# EasyEDA Pro project PR.eprj, board 新大符2.0（下单PCB）
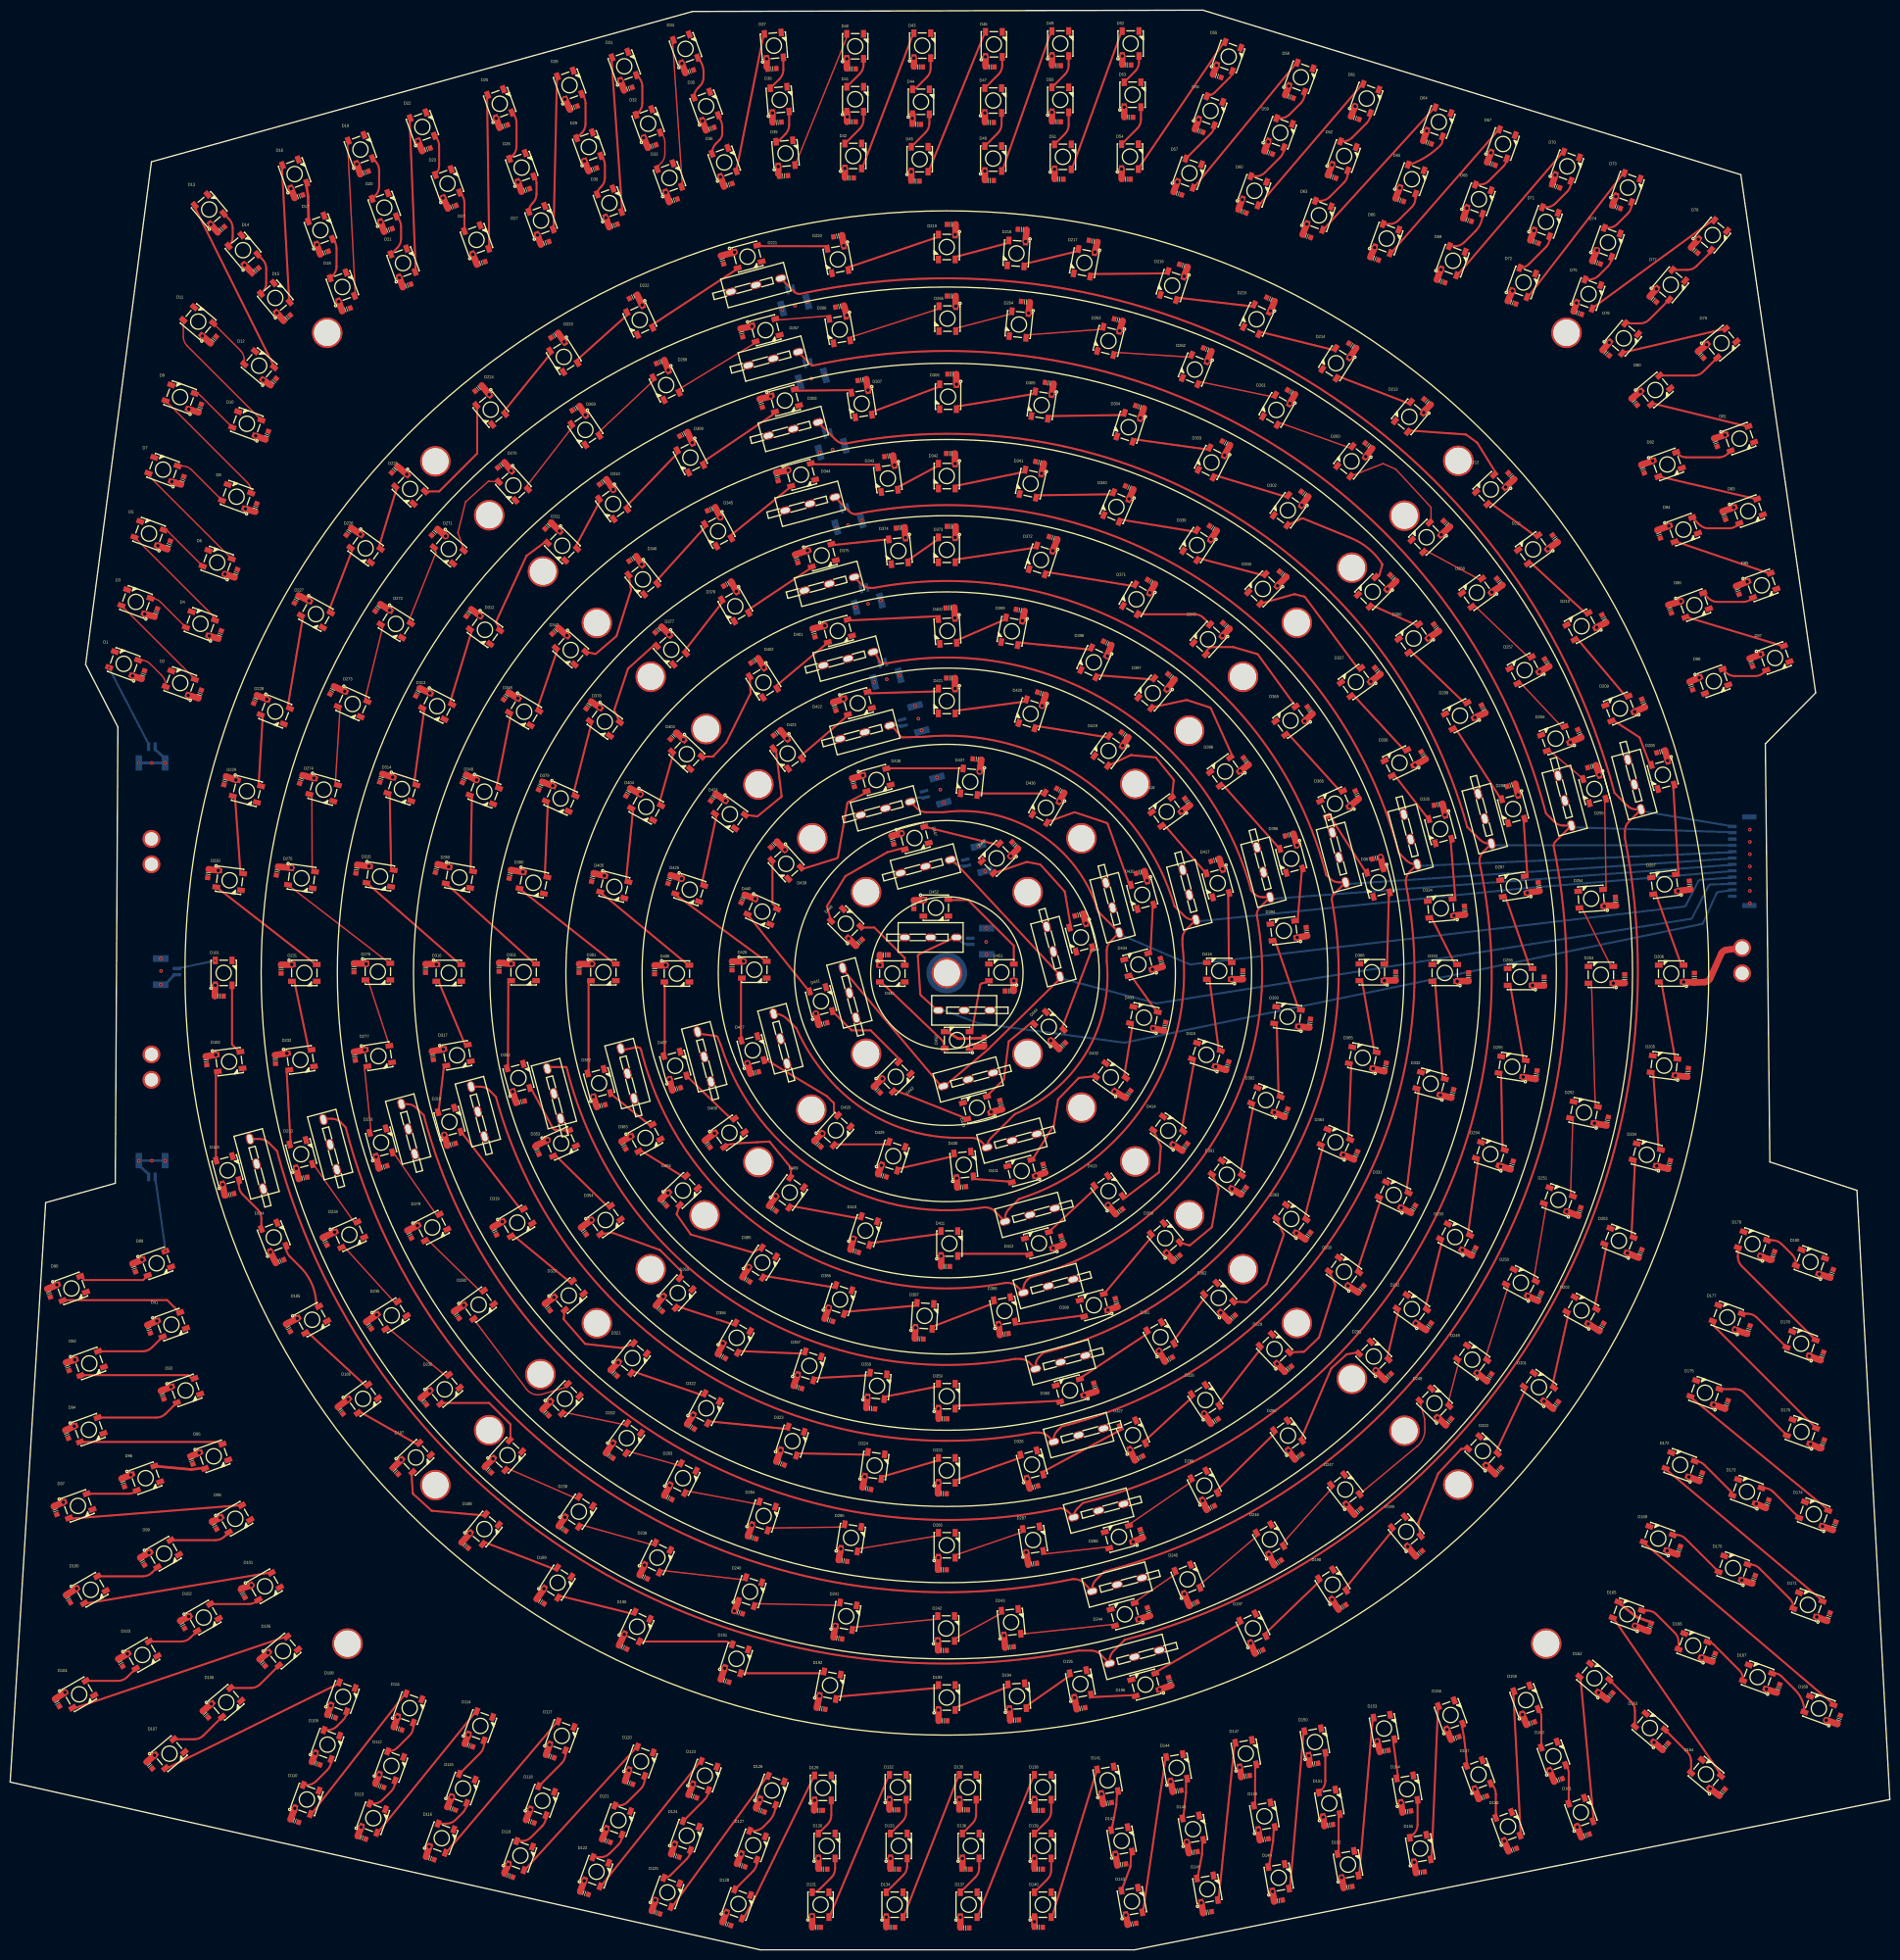
[diagram p2: board, top side]
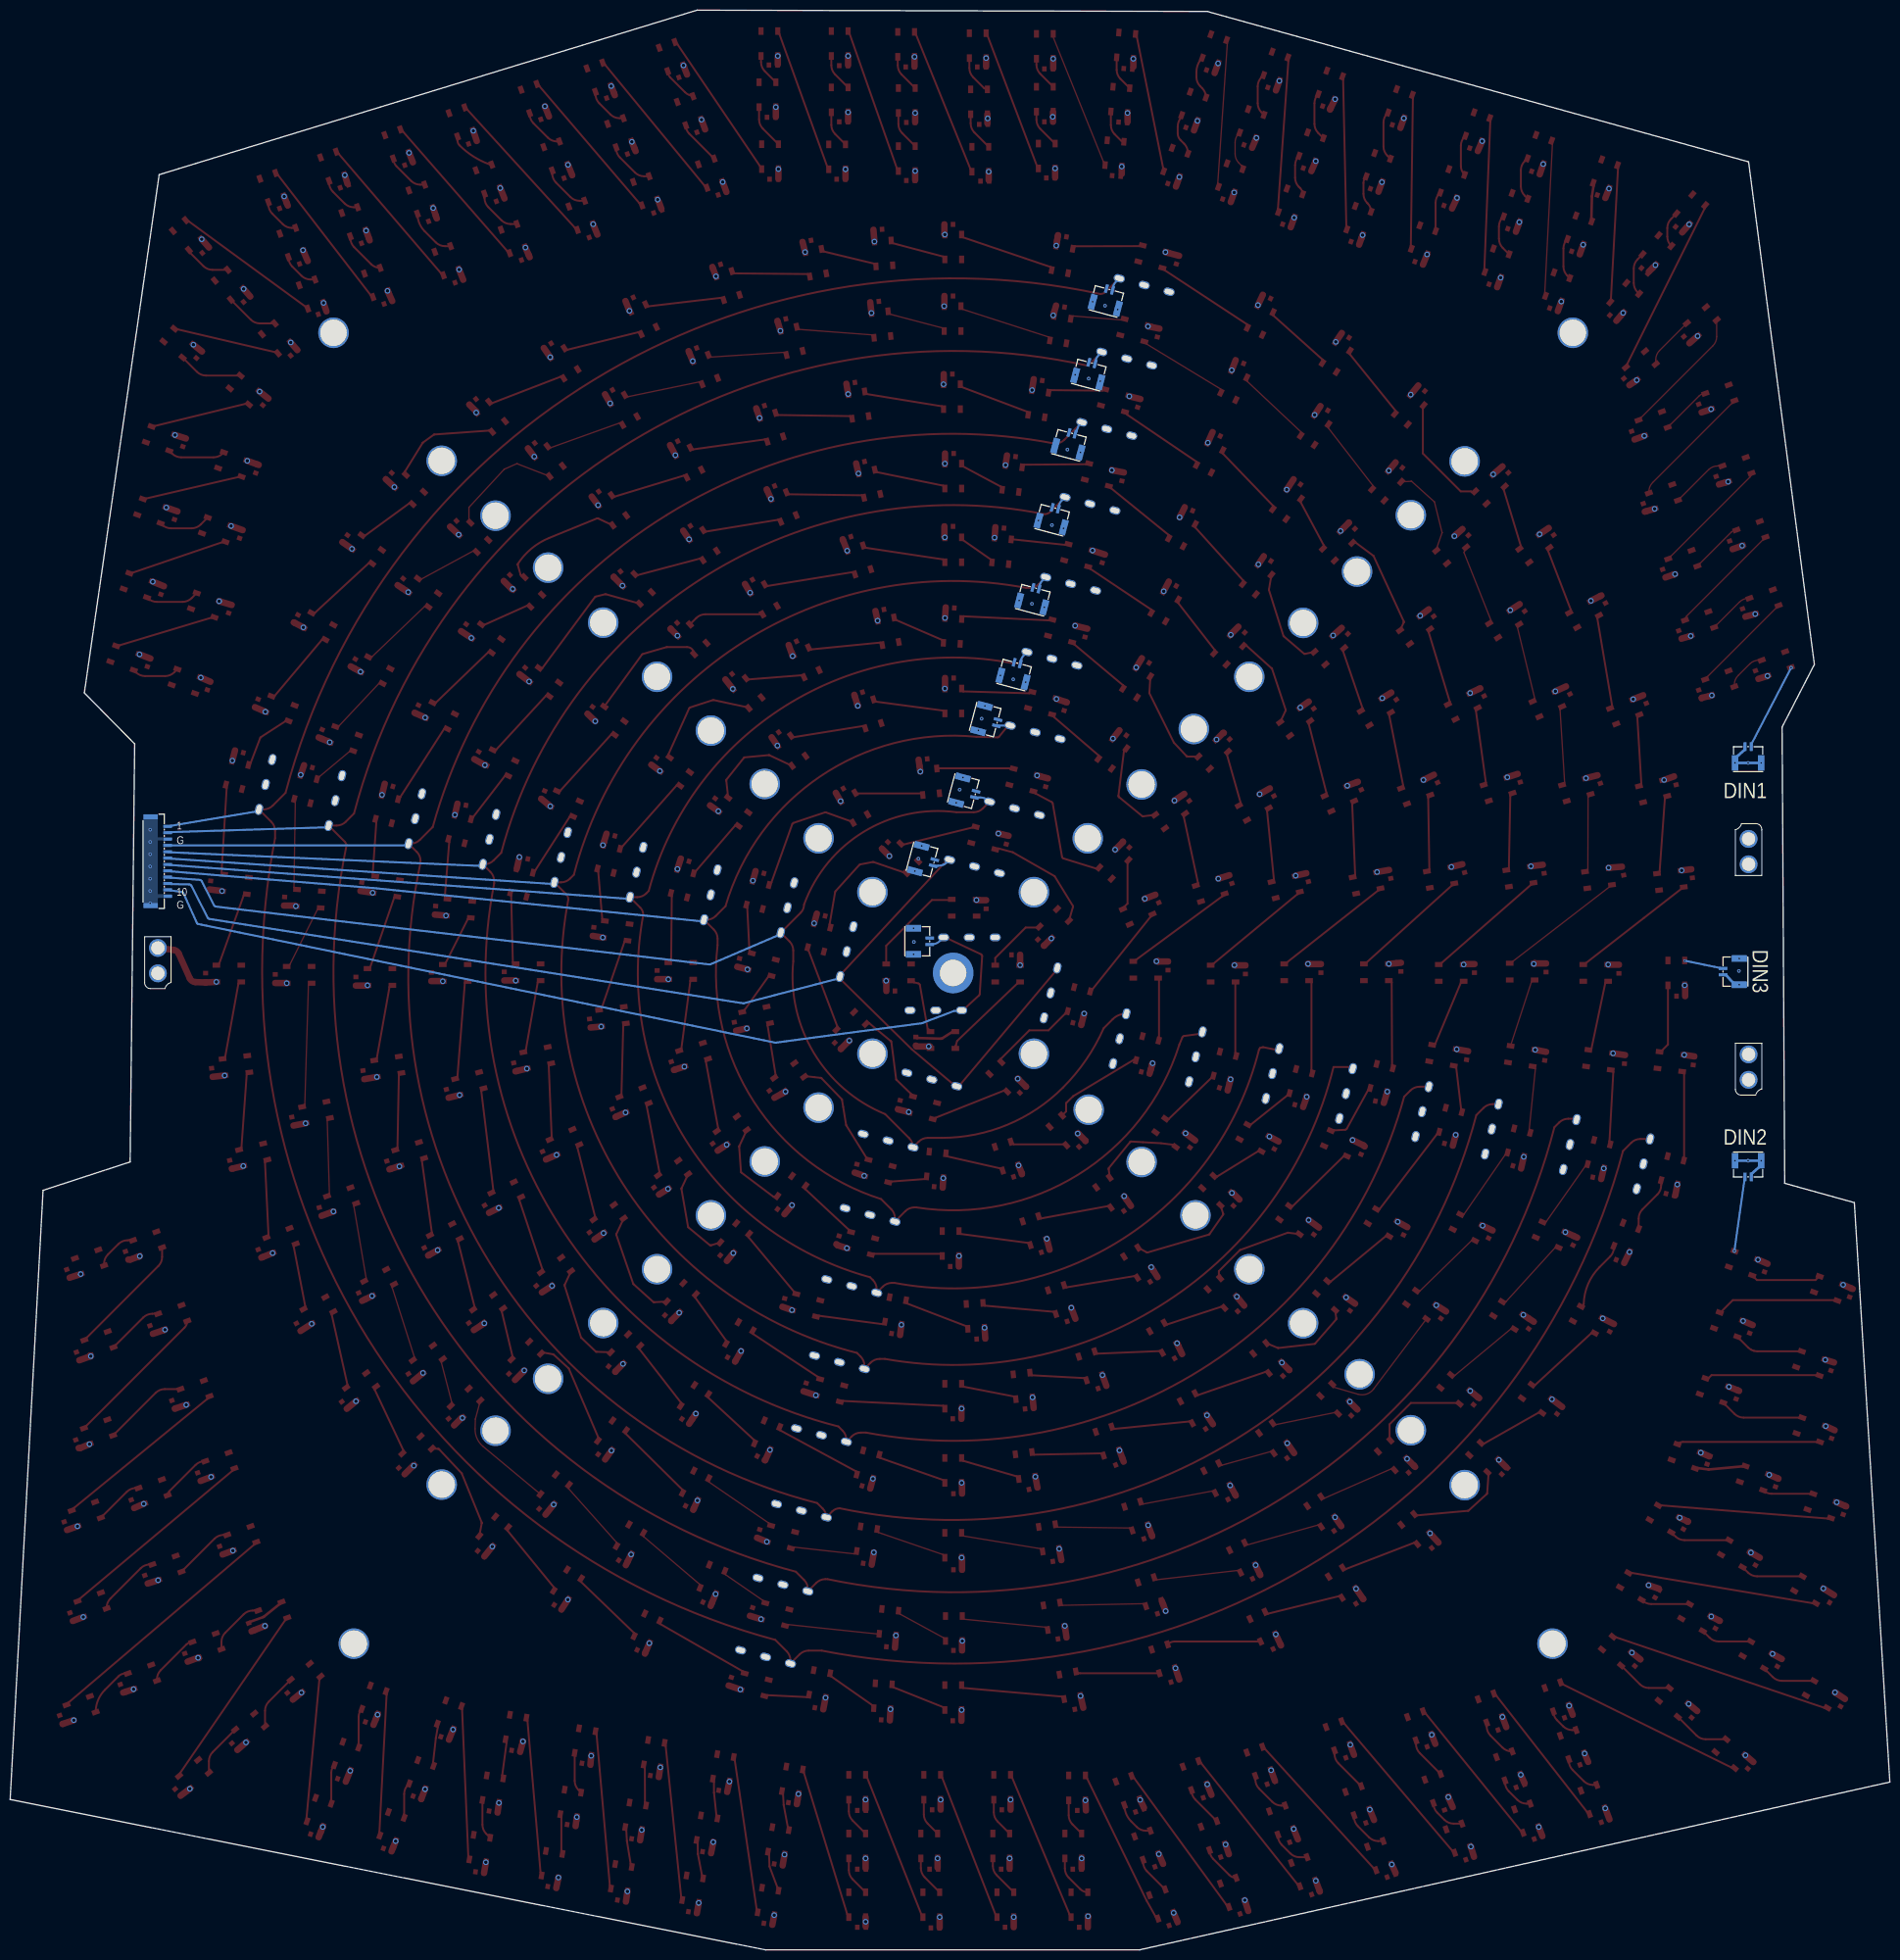
[diagram p3: board, bottom side, seen from below]

Outline 370.08 x 381.76 mm; copper layers: Top Layer, Bottom Layer. Coordinates in mm from the lower left corner of the outline.
Outline path: 0,33.02 6.98,147.07 20.7,150.88 21.21,240.67 14.86,252.98 27.81,351.92 134.37,381.51 234.82,381.76 340.74,349.38 355.47,247.4 345.57,237.36 346.46,155.07 363.6,149.48 370.08,29.59 221.34,0 147.68,0 0,33.02
Stack: Top Layer 0.0356mm / Dielectric 1 0.32mm FR-4 er 4.8 / Bottom Layer 0.0356mm

## Design rules (mm)
spacing Clearance (default): track to track 0.203, other pairs 0.203 to 0.203
track width Width_POWER (default): min 0.508, default 1.27, max 1.524
track width Width_OTHER: min 0.254, default 0.305, max 0.508
differential pair DiffPairsRouting (default): width min 0.381, default 0.381, max 0.381; gap min 0.254, default 0.254
via RoutingVias (default): diameter min 0.254, default 1.27, max 1.778; hole min 0.127, default 0.711, max 2.54

## Placement (name value [footprint] x y rotation side)
  Microswitch  [SW-TH_MICROSWITCH]  151.64 179.32 285 top
C1  100nF  [C_0603#3]  342.77 253.37 290 top
C2  100nF  [C_0603#3]  330.96 248.79 290 top
C3  100nF  [C_0603#3]  340.11 267.59 290 top
C4  100nF  [C_0603#3]  326.77 263.91 290 top
C5  100nF  [C_0603#3]  337.44 282.32 290 top
C6  100nF  [C_0603#3]  324.61 278.64 290 top
C7  100nF  [C_0603#3]  335.79 296.67 290 top
C8  100nF  [C_0603#3]  321.44 291.47 290 top
C9  100nF  [C_0603#3]  268.61 332.87 340 top
C10  100nF  [C_0603#3]  331.6 334.52 320 top
C11  100nF  [C_0603#3]  312.29 332.11 340 top
C12  100nF  [C_0603#3]  308.61 322.2 340 top
C13  100nF  [C_0603]  314.2 314.33 320 top
C14  100nF  [C_0603#3]  323.47 324.87 320 top
C15  100nF  [C_0603#3]  319.79 304.67 310 top
C16  100nF  [C_0603#3]  332.87 313.94 310 top
C17  100nF  [C_0603#3]  242.57 342.14 340 top
C18  100nF  [C_0603#3]  229.87 345.69 340 top
C19  100nF  [C_0603#3]  234.06 358.01 340 top
C20  100nF  [C_0603#3]  237.62 368.81 340 top
C21  100nF  [C_0603#3]  247.74 353.73 340 top
C22  100nF  [C_0603#3]  260.22 349 340 top
C23  100nF  [C_0603#3]  251.84 364.74 340 top
C24  100nF  [C_0603#3]  264.8 360.55 340 top
C25  100nF  [C_0603#3]  273.56 344.42 340 top
C26  100nF  [C_0603#3]  279.02 355.73 340 top
C27  100nF  [C_0603#3]  281.69 328.42 340 top
C28  100nF  [C_0603#3]  286.89 340.49 340 top
C29  100nF  [C_0603#3]  291.59 351.54 340 top
C30  100nF  [C_0603#3]  172.97 294 187.7 top
C31  100nF  [C_0603#3]  237.11 104.01 33.4 top
C32  100nF  [C_0603#3]  304.29 347.09 340 top
C33  100nF  [C_0603#3]  295.66 324.23 340 top
C34  100nF  [C_0603#3]  300.1 336.17 340 top
C35  100nF  [C_0603#3]  316.23 343.03 340 top
C36  100nF  [C_0603#3]  37.34 247.14 70 top
C37  100nF  [C_0603#3]  26.16 250.95 70 top
C38  100nF  [C_0603#3]  28.7 263.14 70 top
C39  100nF  [C_0603#3]  41.27 258.83 70 top
C40  100nF  [C_0603#3]  44.45 270.89 70 top
C41  100nF  [C_0603#3]  48.26 283.85 70 top
C42  100nF  [C_0603#3]  33.91 289.18 70 top
C43  100nF  [C_0603#3]  31.24 276.48 70 top
C44  100nF  [C_0603#3]  40.01 316.87 50 top
C45  100nF  [C_0603#3]  51.82 308.61 50 top
C46  100nF  [C_0603#3]  54.48 321.18 40 top
C47  100nF  [C_0603#3]  48.26 330.45 40 top
C48  100nF  [C_0603#3]  41.53 338.58 40 top
C49  100nF  [C_0603#3]  37.34 303.4 70 top
C50  100nF  [C_0603#3]  130.56 344.3 20 top
C51  100nF  [C_0603#3]  110.87 362.59 20 top
C52  100nF  [C_0603#3]  121.67 366.27 20 top
C53  100nF  [C_0603#3]  126.36 354.97 20 top
C54  100nF  [C_0603#3]  178.18 348.11 0 top
C55  100nF  [C_0603#3]  219.84 370.97 0 top
C56  100nF  [C_0603#3]  152.27 349.12 5 top
C57  100nF  [C_0603#3]  165.23 348.74 0 top
C58  100nF  [C_0603#3]  206.5 348.49 0 top
C59  100nF  [C_0603#3]  151 359.66 5 top
C60  100nF  [C_0603#3]  255.27 337.31 340 top
C61  100nF  [C_0603#3]  192.79 348.23 0 top
C62  100nF  [C_0603#3]  165.61 359.79 0 top
C63  100nF  [C_0603#3]  178.82 370.59 0 top
C64  100nF  [C_0603#3]  165.61 370.21 0 top
C65  100nF  [C_0603#3]  205.99 370.84 0 top
C66  100nF  [C_0603#3]  192.91 370.59 0 top
C67  100nF  [C_0603#3]  192.79 359.66 0 top
C68  100nF  [C_0603#3]  178.44 359.28 0 top
C69  100nF  [C_0603#3]  149.99 370.21 5 top
C70  100nF  [C_0603#3]  205.99 359.79 0 top
C71  100nF  [C_0603#3]  92.71 331.98 20 top
C72  100nF  [C_0603#3]  118.75 339.34 20 top
C73  100nF  [C_0603#3]  97.16 358.9 20 top
C74  100nF  [C_0603#3]  220.22 360.68 0 top
C75  100nF  [C_0603#3]  114.68 350.39 20 top
C76  100nF  [C_0603#3]  87 343.03 20 top
C77  100nF  [C_0603#3]  137.8 358.39 20 top
C78  100nF  [C_0603#3]  101.47 346.33 20 top
C79  100nF  [C_0603#3]  105.28 335.92 20 top
C80  100nF  [C_0603#3]  219.71 348.49 0 top
C81  100nF  [C_0603#3]  78.1 327.53 20 top
C82  100nF  [C_0603#3]  69.72 349.76 20 top
C83  100nF  [C_0603#3]  81.91 354.33 20 top
C84  100nF  [C_0603#3]  74.42 338.46 20 top
C85  100nF  [C_0603#3]  56.81 345.1 20 top
C86  100nF  [C_0603#3]  61.85 334.01 20 top
C87  100nF  [C_0603#3]  133.73 369.7 20 top
C88  100nF  [C_0603#3]  66.17 322.83 20 top
C89  100nF  [C_0603#3]  26.03 76.45 300 top
C90  100nF  [C_0603#3]  117.35 21.46 340 top
C91  100nF  [C_0603#3]  7.62 129.29 290 top
C92  100nF  [C_0603#3]  24.38 134.24 290 top
C93  100nF  [C_0603#3]  314.96 49.91 50 top
C94  100nF  [C_0603#3]  45.8 70.08 300 top
C95  100nF  [C_0603#3]  113.03 11.18 340 top
C96  100nF  [C_0603#3]  11.18 101.47 290 top
C97  100nF  [C_0603#3]  141.1 5.08 340 top
C98  100nF  [C_0603#3]  35.69 96.39 290 top
C99  100nF  [C_0603#3]  11.3 114.81 290 top
C100  100nF  [C_0603#3]  158.75 4.44 0 top
C101  100nF  [C_0603#3]  27.3 122.17 290 top
C102  100nF  [C_0603#3]  246.89 21.72 10 top
C103  100nF  [C_0603#3]  243.2 34.16 10 top
C104  100nF  [C_0603#3]  335.41 57.53 70 top
C105  100nF  [C_0603#3]  322.83 63.5 70 top
C106  100nF  [C_0603#3]  360.04 45.34 70 top
C107  100nF  [C_0603#3]  249.68 9.65 10 top
C108  100nF  [C_0603#3]  348.11 51.44 70 top
C109  100nF  [C_0603#3]  76.33 43.56 340 top
C110  100nF  [C_0603#3]  9.27 48.64 300 top
C111  100nF  [C_0603#3]  22.22 91.95 290 top
C112  100nF  [C_0603#3]  63.25 45.97 340 top
C113  100nF  [C_0603#3]  69.22 22.1 340 top
C114  100nF  [C_0603#3]  72.77 32.26 340 top
C115  100nF  [C_0603#3]  40.21 83.54 300 top
C116  100nF  [C_0603#3]  8.89 86.49 290 top
C117  100nF  [C_0603#3]  21.72 56.52 300 top
C118  100nF  [C_0603#3]  33.91 64.01 300 top
C119  100nF  [C_0603#4]  11.43 69.09 300 top
C120  100nF  [C_0603#3]  202.44 27.43 0 top
C121  100nF  [C_0603#3]  220.85 5.08 10 top
C122  100nF  [C_0603#3]  218.82 16.76 10 top
C123  100nF  [C_0603#3]  60.2 36.7 340 top
C124  100nF  [C_0603#3]  173.36 4.44 0 top
C125  100nF  [C_0603#3]  202.44 4.44 0 top
C126  100nF  [C_0603#3]  216.03 28.83 10 top
C127  100nF  [C_0603#3]  310.13 22.48 20 top
C128  100nF  [C_0603#3]  337.06 30.99 50 top
C129  100nF  [C_0603]  325.88 40.01 50 top
C130  100nF  [C_0603#3]  256.67 36.58 10 top
C131  100nF  [C_0603#3]  299.34 44.58 20 top
C132  100nF  [C_0603#3]  304.8 33.4 20 top
C133  100nF  [C_0603#3]  121.79 32.89 340 top
C134  100nF  [C_0603#3]  147.7 27.43 340 top
C135  100nF  [C_0603#3]  143.89 16.64 340 top
C136  100nF  [C_0603#3]  130.94 18.54 340 top
C137  100nF  [C_0603#3]  134.37 30.23 340 top
C138  100nF  [C_0603#3]  29.97 109.22 290 top
C139  100nF  [C_0603#3]  332.87 93.09 70 top
C140  100nF  [C_0603#3]  359.16 83.44 70 top
C141  100nF  [C_0603#3]  358.01 65.53 70 top
C142  100nF  [C_0603#3]  328.55 78.61 70 top
C143  100nF  [C_0603#3]  343.28 72.9 70 top
C144  100nF  [C_0603#3]  232.92 19.18 10 top
C145  100nF  [C_0603#3]  82.68 18.03 340 top
C146  100nF  [C_0603#3]  263.4 12.32 10 top
C147  100nF  [C_0603#3]  289.94 29.97 20 top
C148  100nF  [C_0603#3]  259.59 24.51 10 top
C149  100nF  [C_0603#4]  86.87 27.81 340 top
C150  100nF  [C_0603#3]  106.3 38.1 340 top
C151  100nF  [C_0603#3]  127.13 7.37 340 top
C152  100nF  [C_0603#3]  102.36 25.27 340 top
C153  100nF  [C_0603#3]  90.3 40.26 340 top
C154  100nF  [C_0603#3]  98.17 14.61 340 top
C155  100nF  [C_0603#3]  187.96 4.32 0 top
C156  100nF  [C_0603#3]  27.43 36.32 310 top
C157  100nF  [C_0603#3]  38.48 46.36 310 top
C158  100nF  [C_0603#3]  49.66 56.52 310 top
C159  100nF  [C_0603#3]  56.01 25.4 340 top
C160  100nF  [C_0603#3]  173.99 27.56 0 top
C161  100nF  [C_0603#3]  188.21 15.88 0 top
C162  100nF  [C_0603#3]  202.44 15.88 0 top
C163  100nF  [C_0603#3]  187.71 27.56 0 top
C164  100nF  [C_0603#3]  174.12 15.88 0 top
C165  100nF  [C_0603#3]  159.13 27.43 0 top
C166  100nF  [C_0603#3]  160.02 15.88 0 top
C167  100nF  [C_0603#3]  270.51 39.12 10 top
C168  100nF  [C_0603#3]  274.95 27.18 10 top
C169  100nF  [C_0603#3]  141.35 347.35 20 top
C170  100nF  [C_0603#3]  50.55 298.07 70 top
C171  100nF  [C_0603#3]  342.26 122.05 70 top
C172  100nF  [C_0603#3]  356.74 116.84 70 top
C173  100nF  [C_0603#3]  356.87 99.57 70 top
C174  100nF  [C_0603#3]  337.95 107.32 70 top
C175  100nF  [C_0603#3]  358.65 133.1 70 top
C176  100nF  [C_0603#3]  229.74 31.24 10 top
C177  100nF  [C_0603#3]  235.71 7.37 10 top
C178  100nF  [C_0603#3]  295.78 19.69 20 top
C179  100nF  [C_0603#3]  284.48 41.66 20 top
C180  100nF  [C_0603#3]  347.09 136.65 70 top
C181  100nF  [C_0603#3]  331.6 191.39 90 top
C182  100nF  [C_0603#3]  330.31 172.67 82.8 top
C183  100nF  [C_0603#3]  326.64 154.56 75.6 top
C184  100nF  [C_0603#3]  320.93 137.03 68.4 top
C185  100nF  [C_0603#3]  313.31 122.56 61.2 top
C186  100nF  [C_0603#3]  304.29 107.19 54 top
C187  100nF  [C_0603#3]  292.99 94.23 46.8 top
C188  100nF  [C_0603#3]  277.37 77.98 39.6 top
C189  100nF  [C_0603#3]  262.25 67.44 32.4 top
C190  100nF  [C_0603#3]  245.87 58.67 25.2 top
C191  100nF  [C_0603#3]  228.35 52.83 108 top
C192  100nF  [C_0603#3]  210.82 47.5 10.8 top
C193  100nF  [C_0603#3]  197.74 45.21 3.6 top
C194  100nF  [C_0603#3]  183.64 45.09 0 top
C195  100nF  [C_0603#3]  159.64 47.5 349.2 top
C196  100nF  [C_0603#3]  140.72 52.96 342 top
C197  100nF  [C_0603#3]  120.65 59.56 334.8 top
C198  100nF  [C_0603#3]  104.39 68.58 327.6 top
C199  100nF  [C_0603#3]  89.53 79.63 320.4 top
C200  100nF  [C_0603#3]  75.82 94.23 313.2 top
C201  100nF  [C_0603#3]  65.02 106.17 306 top
C202  100nF  [C_0603#3]  54.74 122.43 298.8 top
C203  100nF  [C_0603#3]  53.09 135.51 21.6 top
C204  100nF  [C_0603#3]  43.25 148.63 14.4 top
C205  100nF  [C_0603#3]  38.61 175.01 277.2 top
C206  100nF  [C_0603#3]  41.15 187.71 0 top
C207  100nF  [C_0603#3]  38.99 211.84 262.8 top
C208  100nF  [C_0603#3]  42.29 230.12 255.6 top
C209  100nF  [C_0603#3]  48.26 246.13 248.4 top
C210  100nF  [C_0603#3]  56.39 265.81 241.2 top
C211  100nF  [C_0603#3]  66.67 279.15 234 top
C212  100nF  [C_0603#3]  75.69 291.34 226.8 top
C213  100nF  [C_0603#3]  92.2 307.34 219.6 top
C214  100nF  [C_0603#3]  107.19 317.75 212.4 top
C215  100nF  [C_0603#3]  122.68 325.37 205.2 top
C216  100nF  [C_0603#3]  140.21 332.61 288 top
C217  100nF  [C_0603#3]  162.94 337.31 190.8 top
C218  100nF  [C_0603#3]  185.29 339.6 180 top
C219  100nF  [C_0603#3]  199.26 338.58 176.4 top
C220  100nF  [C_0603#3]  213.23 336.3 169.2 top
C221  100nF  [C_0603#3]  231.01 331.47 162 top
C222  100nF  [C_0603#3]  248.16 324.87 154.8 top
C223  100nF  [C_0603#3]  264.29 315.72 147.6 top
C224  100nF  [C_0603#3]  279.02 304.67 140.4 top
C225  100nF  [C_0603#3]  295.53 290.07 133.2 top
C226  100nF  [C_0603#3]  304.16 277.75 126 top
C227  100nF  [C_0603#3]  313.82 262 118.8 top
C228  100nF  [C_0603#3]  321.56 245.36 111.6 top
C229  100nF  [C_0603#3]  324.99 235.84 195 top
C230  100nF  [C_0603#3]  330.71 209.55 97.2 top
C231  100nF  [C_0603#3]  317.88 191.14 90 top
C232  100nF  [C_0603#3]  314.45 163.07 78 top
C233  100nF  [C_0603#3]  308.99 145.29 74 top
C234  100nF  [C_0603#3]  301.12 128.52 66 top
C235  100nF  [C_0603#3]  291.21 112.65 58 top
C236  100nF  [C_0603#3]  283.21 103.89 50 top
C237  100nF  [C_0603#3]  265.3 86.23 42 top
C238  100nF  [C_0603#3]  249.56 76.2 34 top
C239  100nF  [C_0603#3]  232.92 68.07 26 top
C240  100nF  [C_0603#3]  224.15 66.55 108 top
C241  100nF  [C_0603#3]  196.72 59.56 6 top
C242  100nF  [C_0603#3]  183.51 58.93 0 top
C243  100nF  [C_0603#3]  162.94 61.34 350 top
C244  100nF  [C_0603#3]  143.38 66.42 342 top
C245  100nF  [C_0603#3]  124.71 73.41 334 top
C246  100nF  [C_0603#3]  108.71 82.93 326 top
C247  100nF  [C_0603#3]  94.11 94.49 318 top
C248  100nF  [C_0603#3]  81.41 107.95 310 top
C249  100nF  [C_0603#3]  70.61 122.94 306 top
C250  100nF  [C_0603#3]  61.98 139.45 298 top
C251  100nF  [C_0603#3]  163.32 323.47 190 top
C252  100nF  [C_0603#3]  57.66 151.89 12 top
C253  100nF  [C_0603#3]  52.2 175.26 274 top
C254  100nF  [C_0603#3]  53.34 193.04 270 top
C255  100nF  [C_0603#3]  52.58 212.34 258 top
C256  100nF  [C_0603#3]  57.28 230.38 250 top
C257  100nF  [C_0603#3]  63.37 247.9 242 top
C258  100nF  [C_0603#3]  72.39 264.16 234 top
C259  100nF  [C_0603#3]  83.57 279.02 226 top
C260  100nF  [C_0603#3]  96.65 292.23 218 top
C261  100nF  [C_0603#3]  111.38 303.4 210 top
C262  100nF  [C_0603#3]  128.02 312.55 202 top
C263  100nF  [C_0603#3]  144.02 318.26 284 top
C264  100nF  [C_0603#3]  185.29 325.5 180 top
C265  100nF  [C_0603#3]  199.9 324.36 174 top
C266  100nF  [C_0603#3]  218.19 320.8 166 top
C267  100nF  [C_0603#3]  235.71 314.96 158 top
C268  100nF  [C_0603#3]  252.22 306.58 150 top
C269  100nF  [C_0603#3]  267.46 296.04 142 top
C270  100nF  [C_0603#3]  282.83 280.67 138 top
C271  100nF  [C_0603#3]  293.24 269.24 130 top
C272  100nF  [C_0603#3]  302.57 253.32 122 top
C273  100nF  [C_0603#3]  308.99 239.4 114 top
C274  100nF  [C_0603#3]  311.4 232.92 196 top
C275  100nF  [C_0603#3]  316.1 206.38 94 top
C276  100nF  [C_0603#3]  302.01 190.63 90 top
C277  100nF  [C_0603#3]  300.48 172.21 81 top
C278  100nF  [C_0603#3]  295.66 154.43 72 top
C279  100nF  [C_0603#3]  288.16 137.41 63 top
C280  100nF  [C_0603#3]  279.27 122.68 54 top
C281  100nF  [C_0603#3]  271.27 112.78 45 top
C282  100nF  [C_0603#3]  253.62 97.03 36 top
C283  100nF  [C_0603#3]  236.35 87 27 top
C284  100nF  [C_0603#3]  222.76 81.92 108 top
C285  100nF  [C_0603#3]  201.3 75.95 9 top
C286  100nF  [C_0603#3]  183.51 74.8 0 top
C287  100nF  [C_0603#3]  163.96 76.58 351 top
C288  100nF  [C_0603#3]  146.05 81.15 342 top
C289  100nF  [C_0603#3]  129.54 89.03 333 top
C290  100nF  [C_0603#3]  117.98 97.28 324 top
C291  100nF  [C_0603#3]  105.44 105.76 315 top
C292  100nF  [C_0603#3]  87.88 124.97 306 top
C293  100nF  [C_0603#3]  78.61 140.84 297 top
C294  100nF  [C_0603#3]  73.41 154.05 18 top
C295  100nF  [C_0603#3]  67.82 175.9 279 top
C296  100nF  [C_0603#3]  67.69 193.29 270 top
C297  100nF  [C_0603#3]  68.2 212.73 261 top
C298  100nF  [C_0603#3]  73.03 230.63 252 top
C299  100nF  [C_0603#3]  80.26 247.53 243 top
C300  100nF  [C_0603#3]  90.3 263.14 234 top
C301  100nF  [C_0603#3]  105.92 280.29 225 top
C302  100nF  [C_0603#3]  116.71 288.93 216 top
C303  100nF  [C_0603#3]  132.59 298.32 207 top
C304  100nF  [C_0603#3]  147.83 304.42 288 top
C305  100nF  [C_0603#3]  167.72 309 189 top
C306  100nF  [C_0603#3]  185.42 310.13 180 top
C307  100nF  [C_0603#3]  204.6 308.36 171 top
C308  100nF  [C_0603#3]  222.38 303.66 162 top
C309  100nF  [C_0603#3]  239.39 296.55 153 top
C310  100nF  [C_0603#3]  254.89 286.51 144 top
C311  100nF  [C_0603#3]  272.29 270 135 top
C312  100nF  [C_0603#3]  280.8 260.22 126 top
C313  100nF  [C_0603#3]  290.07 244.22 117 top
C314  100nF  [C_0603#3]  295.53 229.24 198 top
C315  100nF  [C_0603#3]  300.98 209.25 99 top
C316  100nF  [C_0603#3]  286.38 204.6 95 top
C317  100nF  [C_0603#3]  287.15 191.52 90 top
C318  100nF  [C_0603#3]  283.97 168.53 74.6 top
C319  100nF  [C_0603#3]  276.23 145.8 59.1 top
C320  100nF  [C_0603#3]  265.94 130.05 48.9 top
C321  100nF  [C_0603#3]  251.59 114.3 38.6 top
C322  100nF  [C_0603#3]  222.25 96.77 28.3 top
C323  100nF  [C_0603#3]  201.55 91.06 18 top
C324  100nF  [C_0603#3]  277.62 15.24 7.7 top
C325  100nF  [C_0603#3]  183.51 89.79 359 top
C326  100nF  [C_0603#3]  168.66 90.81 347.1 top
C327  100nF  [C_0603#3]  151.64 95.76 336.9 top
C328  100nF  [C_0603#3]  133.99 103 326.6 top
C329  100nF  [C_0603#3]  118.87 113.54 316.3 top
C330  100nF  [C_0603#3]  105.79 126.49 306 top
C331  100nF  [C_0603#3]  95.38 141.48 295.7 top
C332  100nF  [C_0603#3]  83.19 176.02 280 top
C333  100nF  [C_0603#3]  81.79 193.17 270 top
C334  100nF  [C_0603#3]  86.87 158.5 15 top
C335  100nF  [C_0603#3]  83.95 212.85 254.6 top
C336  100nF  [C_0603#3]  89.41 230.51 244.3 top
C337  100nF  [C_0603#3]  97.66 246.76 234 top
C338  100nF  [C_0603#2]  107.31 259.59 223.7 top
C339  100nF  [C_0603#3]  122.55 273.81 213.4 top
C340  100nF  [C_0603#3]  138.05 283.59 203.2 top
C341  100nF  [C_0603#3]  151 289.94 282.9 top
C342  100nF  [C_0603#3]  185.17 294.51 180 top
C343  100nF  [C_0603#3]  202.69 292.74 167.1 top
C344  100nF  [C_0603#3]  220.35 287.78 156.9 top
C345  100nF  [C_0603#3]  236.86 279.78 146.6 top
C346  100nF  [C_0603#3]  250.57 270.76 141.4 top
C347  100nF  [C_0603#3]  269.24 251.71 131.2 top
C348  100nF  [C_0603#3]  278.26 235.08 120.9 top
C349  100nF  [C_0603#3]  195.71 121.16 10 top
C350  100nF  [C_0603#3]  281.18 225.43 190.3 top
C351  100nF  [C_0603#3]  272.8 191.64 90 top
C352  100nF  [C_0603#3]  270.76 173.74 78 top
C353  100nF  [C_0603#3]  264.92 156.34 66 top
C354  100nF  [C_0603#3]  255.52 140.51 54 top
C355  100nF  [C_0603#3]  240.54 124.33 42 top
C356  100nF  [C_0603#3]  228.09 116.21 30 top
C357  100nF  [C_0603#3]  213.61 110.74 108 top
C358  100nF  [C_0603#3]  183.64 104.52 0 top
C359  100nF  [C_0603#3]  169.42 106.55 354 top
C360  100nF  [C_0603#3]  155.07 110.74 342 top
C361  100nF  [C_0603#3]  140.08 116.84 330 top
C362  100nF  [C_0603#3]  127.76 126.24 318 top
C363  100nF  [C_0603#3]  112.9 141.48 306 top
C364  100nF  [C_0603#3]  103.76 157.35 294 top
C365  100nF  [C_0603#3]  100.46 166.88 12 top
C366  100nF  [C_0603#3]  96.27 193.42 270 top
C367  100nF  [C_0603#3]  98.42 211.71 258 top
C368  100nF  [C_0603#3]  104.39 229.11 246 top
C369  100nF  [C_0603#3]  113.92 244.98 234 top
C370  100nF  [C_0603#3]  127.64 259.84 222 top
C371  100nF  [C_0603#3]  141.22 268.86 210 top
C372  100nF  [C_0603#3]  154.81 273.81 288 top
C373  100nF  [C_0603#3]  175.26 279.91 186 top
C374  100nF  [C_0603#3]  185.29 280.16 180 top
C375  100nF  [C_0603#3]  205.36 277.88 162 top
C376  100nF  [C_0603#3]  224.66 269.24 150 top
C377  100nF  [C_0603#3]  239.39 260.6 138 top
C378  100nF  [C_0603#3]  255.9 243.97 126 top
C379  100nF  [C_0603#3]  265.18 227.33 114 top
C380  100nF  [C_0603#3]  268.99 214.88 192 top
C381  100nF  [C_0603#3]  255.27 200.41 97.2 top
C382  100nF  [C_0603#3]  255.9 182.37 82.8 top
C383  100nF  [C_0603#3]  251.21 164.72 68.4 top
C384  100nF  [C_0603#3]  242.82 149.35 54 top
C385  100nF  [C_0603#3]  229.62 136.14 39.6 top
C386  100nF  [C_0603#3]  217.81 127.38 105 top
C387  100nF  [C_0603#3]  178.94 120.27 356.4 top
C388  100nF  [C_0603#3]  161.16 123.95 342 top